# EasyEDA Pro project MAX2831_Standalone.eprj (continued)
## Nets (continued)
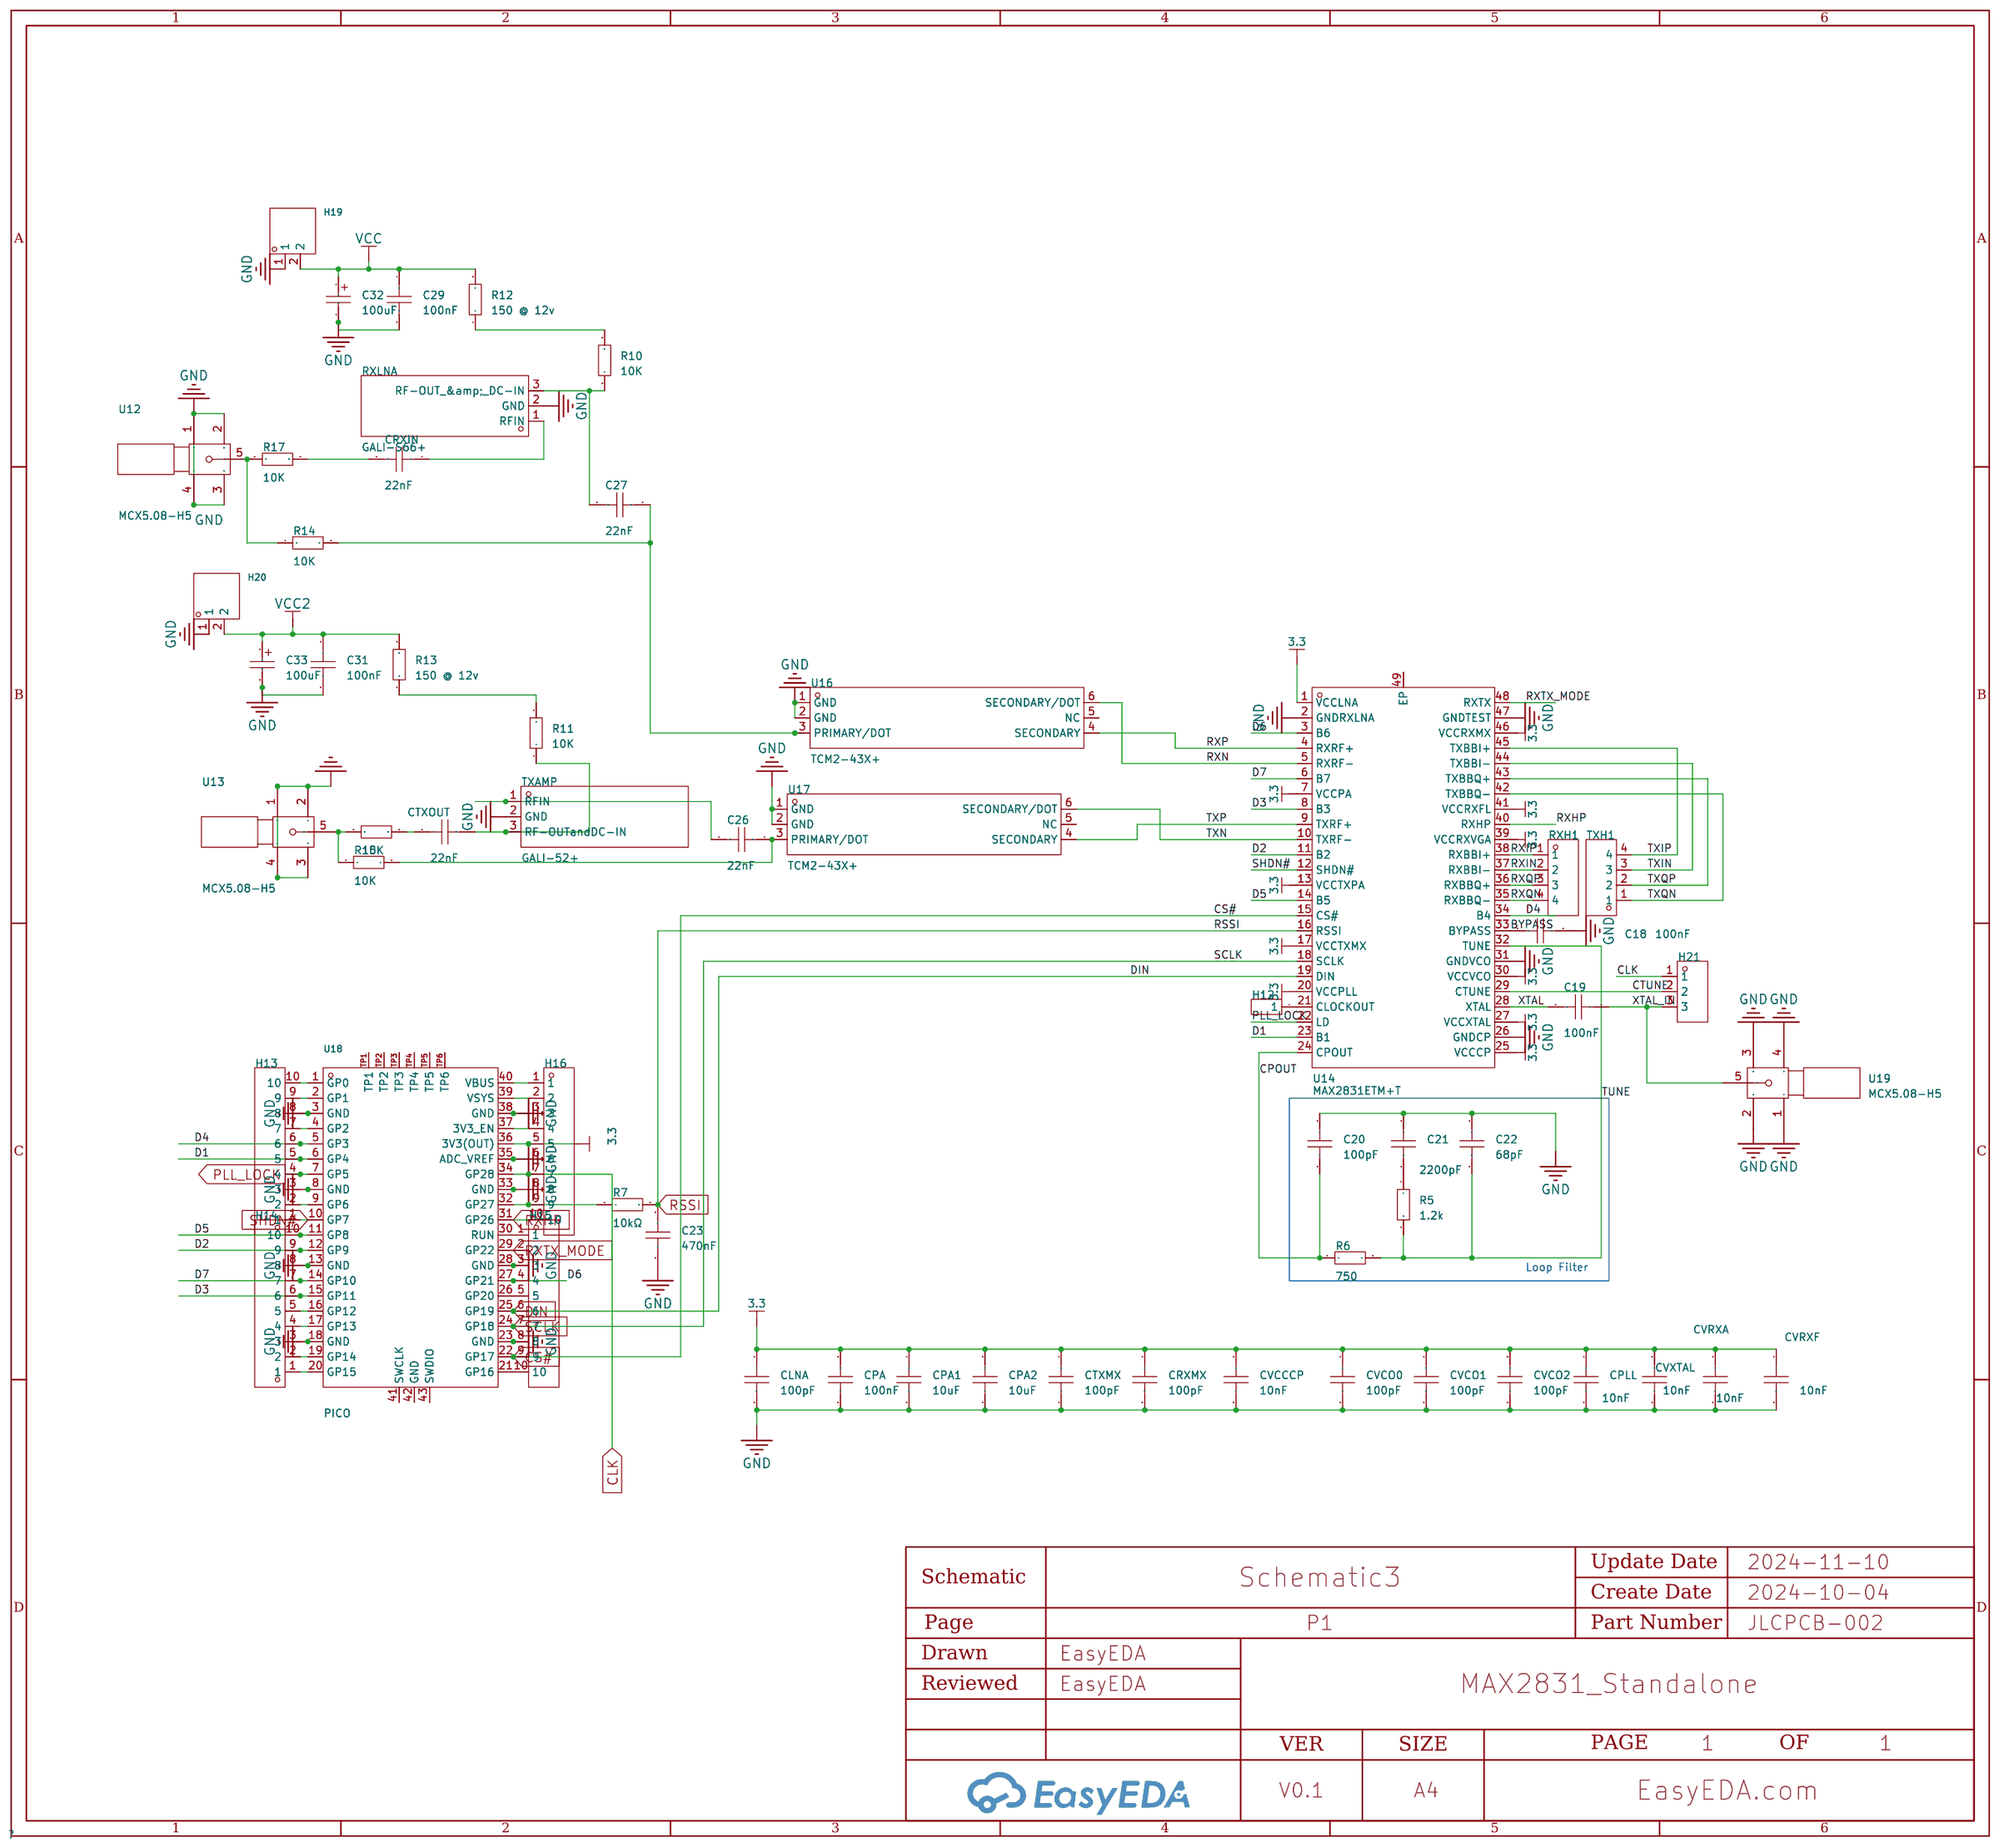
[diagram p2: schematic sheet]

## Parts
C18  100nF  [C0603]
C19  100nF  [C0603]
C20  100pF  [C0603]
C21  2200pF  [C0603]
C22  68pF  [C0603]
C23  470nF  [CAP-TH_L7.2-W2.5-P5.00-D0.5]
C26  22nF  [C0805]
C27  22nF  [C0805]
C29  100nF  [C0805]
C31  100nF  [C0805]
C32  100uF  [CAP-SMD_BD3.0-L3.3-W3.3-RD]
C33  100uF  [CAP-SMD_BD3.0-L3.3-W3.3-RD]
CLNA  100pF  [C0603]
CPA  100nF  [C0603]
CPA1  10uF  [C0603]
CPA2  10uF  [C0603]
CPLL  10nF  [C0603]
CRXIN  22nF  [C0805]
CRXMX  100pF  [C0603]
CTXMX  100pF  [C0603]
CTXOUT  22nF  [C0805]
CVCCCP  10nF  [C0603]
CVCO0  100pF  [C0603]
CVCO1  100pF  [C0603]
CVCO2  100pF  [C0603]
CVRXA  10nF  [C0603]
CVRXF  10nF  [C0603]
CVXTAL  10nF  [C0603]
H12  -  [HDR-TH_1P-V-M_XKB_X4611WV-01I-C28D40]
H13  -  [HDR-TH_10P-P2.54-V-F]
H14  -  [HDR-TH_10P-P2.54-V-F]
H15  -  [HDR-TH_10P-P2.54-V-F]
H16  -  [HDR-TH_10P-P2.54-V-F]
H19  -  [HDR-TH_2P-P2.54-V-M-1]
H20  -  [HDR-TH_2P-P2.54-V-M-1]
H21  -  [HDR-TH_3P-P2.54-V-M]
R5  1.2k  [R0603]
R6  750  [R0603]
R7  10kΩ  [RES-TH_BD1.8-L3.2-P7.20-D0.4]
R10  10K  [R0603]
R11  10K  [R0603]
R12  150 @ 12v  [R0603]
R13  150 @ 12v  [R0603]
R14  10K  [R0201]
R15  10K  [R0201]
R16  10K  [R0201]
R17  10K  [R0201]
RXH1  -  [HDR-TH_4P-P2.54-V-M]
RXLNA  GALI-S66+  [SOT-89-3_L4.5-W2.5-P1.50-LS4.2-BR]
TXAMP  GALI-52+  [SOT-89-3_L4.5-W2.5-P1.50-LS4.2-BR]
TXH1  -  [HDR-TH_4P-P2.54-V-M]
U12  MCX5.08-H5  [SMA-TH_MCX5.08-H5]
U13  MCX5.08-H5  [SMA-TH_MCX5.08-H5]
U14  MAX2831ETM+T  [TQFN-48_L7.0-W7.0-P0.50-TL-EP5.6]
U16  TCM2-43X+  [IND-SMD_6P-L4.1-W3.8-P1.27-TL]
U17  TCM2-43X+  [IND-SMD_6P-L4.1-W3.8-P1.27-TL]
U18  PICO  [COMM-SMD_L51.0-W21.0-P2.54_SC0916]
U19  MCX5.08-H5  [SMA-TH_MCX5.08-H5]

## Library data of the parts
C18-C22 CLNA CPA CPA1 CPA2 CPLL CRXMX CTXMX CVCCCP CVCO0-CVCO2 CVRXA CVRXF CVXTAL = CAP_0603: Supplier Footprint: 0603
C23 = C241J474J20C000: Capacitance:470nF Tolerance:±5% Tolerance:±5% Voltage Rated: Dielectric Material:Metallized Polyester Film Capacitor Operating Temperature:-55℃~+125℃ Operating Temperature:-55℃~+125℃; LCSC Part Name: 470nF ±5% 63V; Supplier Part: C5121927; Manufacturer: faratronic(厦门法拉); Supplier Footprint: 插件,P=5mm; JLCPCB Part Class: Extended Part; Datasheet: https://atta.szlcsc.com/upload/public/pdf/source/20220309/53E9D6585E584592026F1B9FCED89B93.pdf; Supplier: LCSC; Tolerance: ±5%; Dielectric Material: Metallized Polyester Film Capacitor; Operating Temperature: -55℃~+125℃
C26 C27 C29 C31 CRXIN CTXOUT = CAP_0805: Supplier Footprint: 0805
C32 C33 = C_Ele_SMD_3x5.4mm: Supplier Footprint: SMD,3x5.4mm
H12 = HDR-M_2.54_1x1P: Supplier Footprint: Through
H13-H16 = HDR-F_2.54_1x10P: Supplier Footprint: Through
H19 H20 = HDR-M_2.54_1x2P: Supplier Footprint: Through
H21 = HDR-M_2.54_1x3P: Supplier Footprint: Through
R5 R6 R10-R13 = Res_0603: Supplier Footprint: 0603
R7 = Res_AXIAL-1/8W: Supplier Footprint: Through
R14-R17 = Res_0201: Supplier Footprint: 0201
RXH1 TXH1 = HDR-M_2.54_1x4P: Supplier Footprint: Through
RXLNA = GALI-S66+: Applications:Mobile Phone；PCS Frequency Range:0Hz~3GHz Frequency Range:0Hz~3GHz Gain:16.4dB Noise Figure:2.4dB Supply Voltage:3V~4V Supply Voltage:3V~4V Supply Current:16mA; Supplier Part: C3193274; Manufacturer: Mini-Circuits; Supplier Footprint: SOT-89; JLCPCB Part Class: Extended Part; Supplier: LCSC; Applications: Mobile Phone；PCS; Frequency Range: 0Hz~3GHz; Gain: 16.4dB; Noise Figure: 2.4dB; Supply Voltage: 3V~4V; Supply Current: 16mA
TXAMP = GALI-52+: Applications:Cellular,PCS Frequency Range:0Hz~2GHz Frequency Range:0Hz~2GHz Gain:14.4dB Noise Figure:2.7dB Supply Voltage:4V~4.8V Supply Voltage:4V~4.8V Supply Current:50mA; Supplier Part: C2683445; Manufacturer: Mini-Circuits; Supplier Footprint: SOT-89-3; JLCPCB Part Class: Extended Part; Datasheet: https://atta.szlcsc.com/upload/public/pdf/source/20210107/C2683445_4C019D776B336260B8EA539DE99FD577.pdf; Supplier: LCSC; Applications: Cellular,PCS; Frequency Range: 0Hz~2GHz; Gain: 14.4dB; Noise Figure: 2.7dB; Supply Voltage: 4V~4.8V; Supply Current: 50mA
U12 U13 U19 = MCX5.08-H5_C9900009324: Supplier Part: C9900009324; Supplier Footprint: COAX-F; JLCPCB Part Class: Extended Part; Supplier: LCSC
U14 = MAX2831ETM+T: Frequency Range:2.4GHz Frequency Range:2.4GHz Interface:SPI Operating Voltage:2.7V~3.6V Operating Voltage:2.7V~3.6V Applications:WiFi Output Power:21dBm Data Rate:54Mbps Current Of Transmitting:82mA Sensitivity:-76dBm Receive Current:62mA Operating Temper; Supplier Part: C2152047; Manufacturer: ADI(亚德诺)/MAXIM(美信); Supplier Footprint: TQFN-48-EP(7x7); JLCPCB Part Class: Extended Part; Datasheet: https://atta.szlcsc.com/upload/public/pdf/source/20210601/D5E13A4F591163B65DE03F91E5182685.pdf; Supplier: LCSC; Frequency Range: 2.4GHz; Interface: SPI; Operating Voltage: 2.7V~3.6V; Applications: WiFi; Output Power: 21dBm; Data Rate: 54Mbps; Current Of Transmitting: 82mA; Sensitivity: -76dBm; Receive Current: 62mA; Operating Temperature: -40℃~+85℃
U16 U17 = TCM2-43X+: Frequency Range:10MHz~4GHz Frequency Range:10MHz~4GHz Impedance Ratio-Unbalanced/Balanced:1:2 Insertion Loss (Max):3dB Phase Balance:7° Return Loss (Min):14.98dB; LCSC Part Name: 射频变压器; Supplier Part: C2885644; Manufacturer: Mini-Circuits; Supplier Footprint: SMD-6P; JLCPCB Part Class: Extended Part; Datasheet: https://atta.szlcsc.com/upload/public/pdf/source/20210825/C2885644_24D8D5254C12C7AF6CFE8387515C0B6D.pdf; Supplier: LCSC; Frequency Range: 10MHz~4GHz; Impedance Ratio-Unbalanced/Balanced: 1:2; Insertion Loss (Max): 3dB; Phase Balance: 7°; Return Loss (Min): 14.98dB
U18 = PICO: Supplier Part: C7203002; Manufacturer: Raspberry Pi(树莓派); JLCPCB Part Class: Extended Part; Datasheet: https://atta.szlcsc.com/upload/public/pdf/source/20230906/086376002DDC9866828648BC93E51F8B.pdf; Supplier: LCSC

## Nets
GND: C18.1 C20.1 C21.1 C22.1 C23.1 C29.2 C31.2 C32.2 C33.2 CLNA.2 CPA.2 CPA1.2 CPA2.2 CPLL.2 CRXMX.2 CTXMX.2 CVCCCP.2 CVCO0.2 CVCO1.2 CVCO2.2 CVRXA.2 CVRXF.2 CVXTAL.2 H13.3 H13.8 H14.3 H14.8 H15.3 H15.8 H16.3 H16.6 H16.8 H19.1 H20.1 RXLNA.2(GND) TXAMP.2(GND) U12.1 U12.2 U12.3 U12.4 U13.1 U13.2 U13.3 U13.4 U14.2(GNDRXLNA) U14.26(GNDCP) U14.31(GNDVCO) U14.47(GNDTEST) U16.1(GND) U16.2(GND) U17.1(GND) U17.2(GND) U18.3(GND) U18.8(GND) U18.13(GND) U18.18(GND) U18.23(GND) U18.28(GND) U18.33(GND) U18.35(ADC_VREF) U18.38(GND) U19.1 U19.2 U19.3 U19.4
VCC: C29.1 C32.1 H19.2 R12.2
VCC2: C31.1 C33.1 H20.2 R13.2
3.3: CLNA.1 CPA.1 CPA1.1 CPA2.1 CPLL.1 CRXMX.1 CTXMX.1 CVCCCP.1 CVCO0.1 CVCO1.1 CVCO2.1 CVRXA.1 CVRXF.1 CVXTAL.1 H16.5 U14.1(VCCLNA) U14.7(VCCPA) U14.13(VCCTXPA) U14.17(VCCTXMX) U14.20(VCCPLL) U14.25(VCCCP) U14.27(VCCXTAL) U14.30(VCCVCO) U14.39(VCCRXVGA) U14.41(VCCRXFL) U14.46(VCCRXMX) U18.36(3V3(OUT))
BYPASS: C18.2 U14.33(BYPASS)
CLK: H16.7 H21.1 U18.34(GP28)
CPOUT: C20.2 R6.1 U14.24(CPOUT)
CS#: H15.9 U14.15(CS#) U18.22(GP17)
CTUNE: H21.2 U14.29(CTUNE)
D1: H13.5 U14.23(B1) U18.6(GP4)
D2: H14.9 U14.11(B2) U18.12(GP9)
D3: H14.6 U14.8(B3) U18.15(GP11)
D4: H13.6 U14.34(B4) U18.5(GP3)
D5: H14.10 U14.14(B5) U18.11(GP8)
D6: H15.4 U14.3(B6) U18.27(GP21)
D7: H14.7 U14.6(B7) U18.14(GP10)
DIN: H15.6 U14.19(DIN) U18.25(GP19)
PLL_LOCK: H13.4 U14.22(LD) U18.7(GP5)
RSSI: C23.2 R7.2 U14.16(RSSI)
RXHP: H16.10 U14.40(RXHP) U18.31(GP26)
RXIN: RXH1.2 U14.37(RXBBI-)
RXIP: RXH1.1 U14.38(RXBBI+)
RXN: U14.5(RXRF-) U16.6(SECONDARY/DOT)
RXP: U14.4(RXRF+) U16.4(SECONDARY)
RXQN: RXH1.4 U14.35(RXBBQ-)
RXQP: RXH1.3 U14.36(RXBBQ+)
RXTX_MODE: H15.2 U14.48(RXTX) U18.29(GP22)
SCLK: H15.7 U14.18(SCLK) U18.24(GP18)
SHDN#: H13.1 U14.12(SHDN#) U18.10(GP7)
TUNE: C22.2 R5.2 R6.2 U14.32(TUNE)
TXIN: TXH1.3 U14.44(TXBBI-)
TXIP: TXH1.4 U14.45(TXBBI+)
TXN: U14.10(TXRF-) U17.6(SECONDARY/DOT)
TXP: U14.9(TXRF+) U17.4(SECONDARY)
TXQN: TXH1.1 U14.42(TXBBQ-)
TXQP: TXH1.2 U14.43(TXBBQ+)
XTAL: C19.2 U14.28(XTAL)
XTAL_IN: C19.1 H21.3 U19.5
$1N1511: H12.1 U14.21(CLOCKOUT)
$1N2412: H14.1 U18.20(GP15)
$1N2414: H14.2 U18.19(GP14)
$1N2418: H14.4 U18.17(GP13)
$1N2420: H14.5 U18.16(GP12)
$1N2434: H13.2 U18.9(GP6)
$1N2444: H13.7 U18.4(GP2)
$1N2448: H13.9 U18.2(GP1)
$1N3367: C21.2 R5.1
$1N4614: H15.1 U18.30(RUN)
$1N4622: H15.5 U18.26(GP20)
$1N4632: H15.10 U18.21(GP16)
$1N4636: H16.2 U18.39(VSYS)
$1N5241: H16.9 R7.1 U18.32(GP27)
$1N12697: C26.1 R15.2 U17.3(PRIMARY/DOT)
$1N12710: C26.2 TXAMP.1(RFIN)
$1N12721: CTXOUT.1 R11.1 TXAMP.3(RF-OUTandDC-IN)
$1N12761: C27.1 R14.2 U16.3(PRIMARY/DOT)
$1N12820: R10.2 R12.1
$1N12851: R11.2 R13.1
$1N13115: C27.2 R10.1 RXLNA.3(RF-OUT &amp; DC-IN)
$1N13128: CRXIN.1 RXLNA.1(RFIN)
$1N13355: R14.1 R17.1 U12.5
$1N13417: CRXIN.2 R17.2
$1N13419: CTXOUT.2 R16.2
$1N13420: R15.1 R16.1 U13.5
$1N14592: H13.10 U18.1(GP0)
$1N14693: H16.1 U18.40(VBUS)
$1N14747: H16.4 U18.37(3V3_EN)

Not connected (* = marked no-connect by the designer): U14 49(EP); U16 5(NC); U17 5(NC); U18 41(SWCLK) 42(GND) 43(SWDIO) TP1 TP2 TP3 TP4 TP5 TP6

## Notes on the sheet
- Loop Filter

# Board PCB1
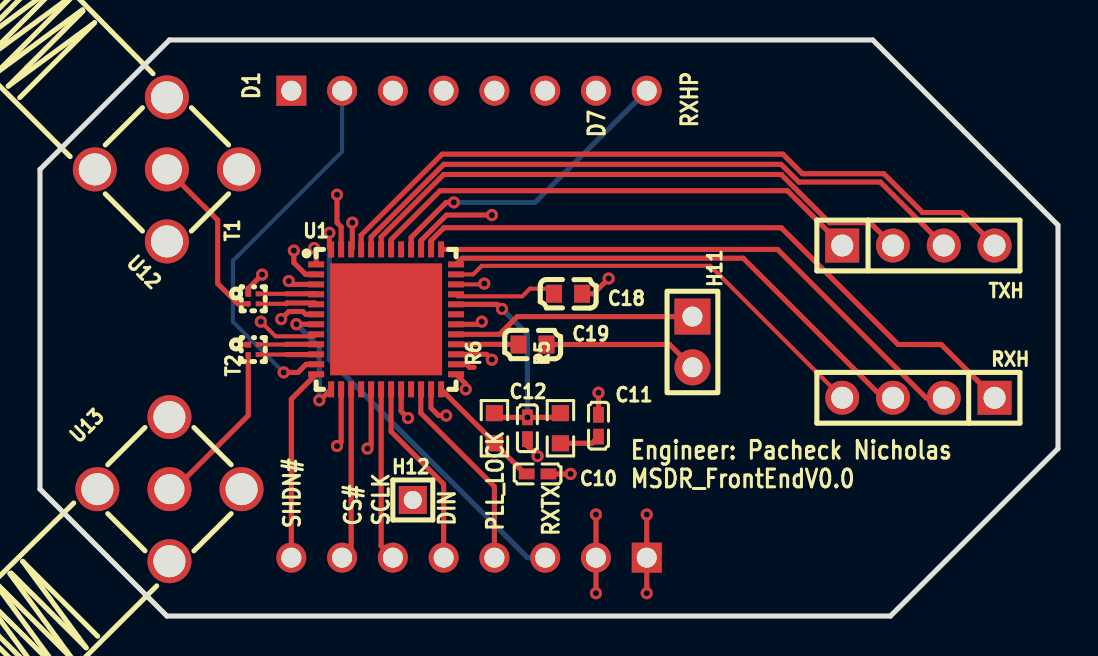
[diagram p3: board, top side]
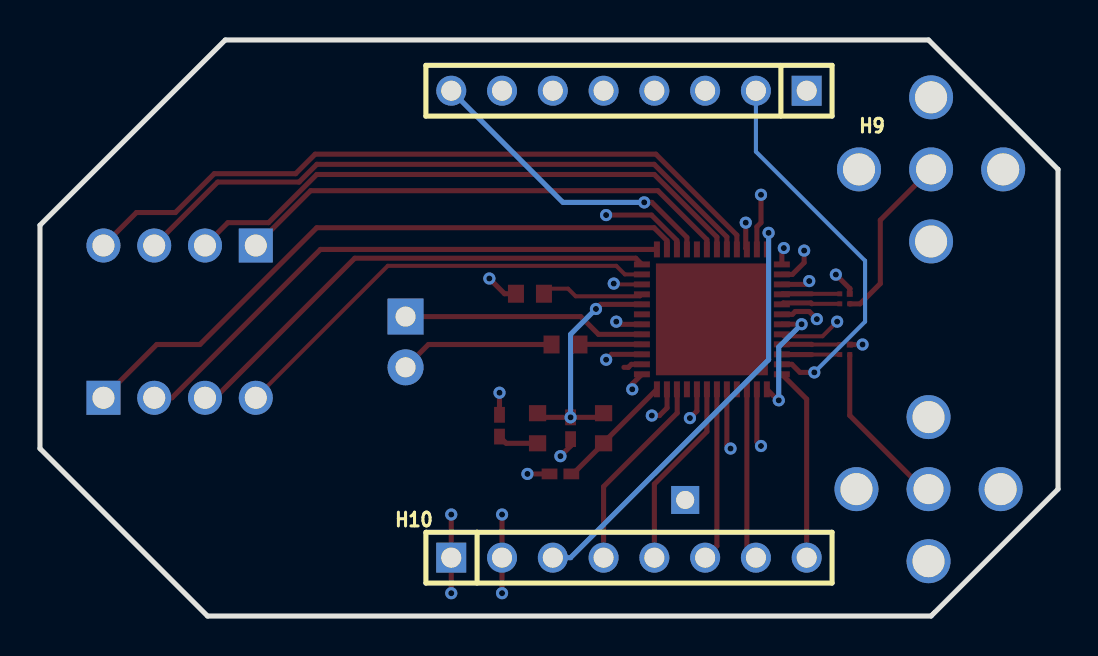
[diagram p4: board, bottom side, seen from below]

Outline 50.93 x 28.83 mm; copper layers: Top Layer, GND, Inner2, Inner3, 3.3, Bottom Layer. Coordinates in mm from the lower left corner of the outline.
Outline path: 0,22.35 0,6.35 6.35,0 42.55,0 50.93,8.38 50.93,19.56 41.66,28.83 6.48,28.83 0,22.35
Stack: Top Layer 0.035mm 外层铜厚1oz / Dielectric1 0.0994mm 3313 RC57% 4.2mil / GND 0.0152mm 内层铜厚 / Dielectric2 0.55mm 0.55mm H/H不含铜 / Inner2 0.0152mm 内层铜厚 / Dielectric3 0.1088mm 2116 RC54% 4.9mil / Inner3 0.0152mm 内层铜厚 / Dielectric4 0.55mm 0.55mm H/H不含铜 / 3.3 0.0152mm 内层铜厚 / Dielectric5 0.0994mm 3313 RC57% 4.2mil / Bottom Layer 0.035mm 外层铜厚1oz

## Design rules (mm)
template: JLCPCB Capability(Two Layers Board)
spacing copperThickness1oz (default): track to track 0.102, other pairs 0.152 to 0.3
spacing copperThickness2oz: track to track 0.203, other pairs 0.152 to 0.3
track width copperThickness1oz (default): min 0.127, default 0.254, max 2.54
track width copperThickness2oz: min 0.203, default 0.254, max 2.54
differential pair differentialPair (default): width min 0.127, default 0.254, max 2.54; gap min 0.152, default 0.152
via viaSize (default): diameter min 0.5, default 0.61, max 10; hole min 0.3, default 0.305, max 6.3

## Placement (name value [footprint] x y rotation side)
C10  100pF  [C0402]  24.89 7.11 180 top
C11  2200pF  [C0402]  27.94 9.53 270 top
C12  68pF  [C0402]  24.38 9.4 90 top
C18  100nF  [C0603]  26.42 16.13 180 top
C19  100nF  [C0603]  24.64 13.59 180 top
H9  -  [HDR-TH_8P-P2.54-V-M]  21.46 26.29 0 bottom
H10  -  [HDR-TH_8P-P2.54-V-M]  21.46 2.92 180 bottom
H11  -  [HDR-TH_2P-P2.54-V-M-1]  32.64 13.72 270 top
H12  -  [HDR-TH_1P-V-M_XKB_X4611WV-01I-C28D40]  18.65 5.81 0 top
R5  1.2k  [R0603]  26.04 9.4 90 top
R6  750  [R0603]  22.73 9.4 90 top
RXH  -  [HDR-TH_4P-P2.54-V-M]  43.94 10.92 180 top
T1  BD2327N50100AHF  [XFMR-SMD_4P-L1.1-W1.1-P0.50-BL]  10.67 15.88 270 top
T2  BD2327N50100AHF  [XFMR-SMD_4P-L1.1-W1.1-P0.50-BL]  10.67 13.34 270 top
TXH  -  [HDR-TH_4P-P2.54-V-M]  43.94 18.54 0 top
U1  MAX2831ETM+T  [tqfn-48_l7.0-w7.0-p0.50-tl-ep5.6]  17.32 14.85 0 top
U12  MCX5.08-H5  [SMA-TH_MCX5.08-H5]  6.35 22.35 135 top
U13  MCX5.08-H5  [SMA-TH_MCX5.08-H5]  6.48 6.35 225 top

## Footprints (pads in the part's own frame, mm; a bottom-side part is the same pattern mirrored in y, then rotated)
C0402
  rect 0.79x0.54 smd: 1(-0.545,0) 2(0.545,0)
C0603
  rect 0.8x0.9 smd: 1(-0.7,0) 2(0.7,0)
HDR-TH_1P-V-M_XKB_X4611WV-01I-C28D40
  rect 1.4x1.4 hole 0.9: 1(0,0)
HDR-TH_2P-P2.54-V-M-1
  rect 1.8x1.8 hole 1: 1(-1.27,0)
  round 1.8 hole 1: 2(1.27,0)
HDR-TH_4P-P2.54-V-M
  rect 1.7x1.7 hole 1.1: 1(-3.81,0)
  round 1.7 hole 1.1: 2(-1.27,0) 3(1.27,0) 4(3.81,0)
HDR-TH_8P-P2.54-V-M
  rect 1.5x1.5 hole 1: 1(-8.89,0)
  round 1.5 hole 1: 2(-6.35,0) 3(-3.81,0) 4(-1.27,0) 5(1.27,0) 6(3.81,0) 7(6.35,0) 8(8.89,0)
R0603
  rect 0.806x0.864 smd: 1(-0.753,0) 2(0.753,0)
SMA-TH_MCX5.08-H5
  round 2.2 hole 1.6: 1(-2.55,-2.55) 2(-2.55,2.55) 3(2.55,2.55) 4(2.55,-2.55)
  round 2.2 hole 1.5: 5(0,0)
tqfn-48_l7.0-w7.0-p0.50-tl-ep5.6
  rect 0.8x0.3 smd: 1(-3.5,2.751) 2(-3.5,2.251) 3(-3.5,1.75) 4(-3.5,1.251) 5(-3.5,0.75) 6(-3.5,0.252) 7(-3.5,-0.249) 8(-3.5,-0.75) 9(-3.5,-1.25) 10(-3.5,-1.75) 11(-3.5,-2.249) 12(-3.5,-2.748) 25(3.5,-2.748) 26(3.5,-2.249) 27(3.5,-1.75) 28(3.5,-1.25) 29(3.5,-0.75) 30(3.5,-0.249) 31(3.5,0.252) 32(3.5,0.75) 33(3.5,1.251) 34(3.5,1.75) 35(3.5,2.251) 36(3.5,2.751)
  rect 0.3x0.8 smd: 13(-2.751,-3.5) 14(-2.251,-3.5) 15(-1.75,-3.5) 16(-1.25,-3.5) 17(-0.75,-3.5) 18(-0.251,-3.5) 19(0.249,-3.5) 20(0.75,-3.5) 21(1.25,-3.5) 22(1.75,-3.5) 23(2.251,-3.5) 24(2.751,-3.5) 37(2.751,3.5) 38(2.251,3.5) 39(1.75,3.5) 40(1.25,3.5) 41(0.75,3.5) 42(0.251,3.5) 43(-0.251,3.5) 44(-0.75,3.5) 45(-1.25,3.5) 46(-1.75,3.5) 47(-2.251,3.5) 48(-2.751,3.5)
  rect 5.6x5.6 smd: 49(0,0.001)
XFMR-SMD_4P-L1.1-W1.1-P0.50-BL
  rect 0.3x0.3 smd: 1(-0.25,-0.25)
  rect 0.25x0.25 smd: 2(0.25,-0.25) 3(0.25,0.25) 4(-0.25,0.25)

## Nets
As in the schematic.

Pads without a net: U1 49

## Via types
v1: diameter 0.61, hole 0.305, Top Layer to Bottom Layer, 33 vias

## Routing (per net, layer and track width the routed paths; a pad name or vN(x,y) marks a point on that pad's centre or on a via; arc(x,y) is an arc through that point)
GND: length 16.5
  Top Layer w0.254: v1(12.7,18.29) 12.7,17.69 13.29,17.1 U1.2 ; 20.82,12.6 21.34,12.6 21.49,12.45 21.72,12.45 ; T1.1 10.42,16.38 10.41,16.38 10.41,16.39 v1(11.11,17.09) ; C18.1 27.69,16.13 v1(28.45,16.89) ; v1(30.35,1.14) H10.1 v1(30.35,5.08) ; U1.47 15.06,19.48 14.86,19.69 v1(14.86,21.08) ; C12.1 24.38,8.51 v1(24.89,8) ; v1(27.94,11.18) C11.1 ; T2.1 9.78,13.59 v1(9.78,13.59) ; v1(26.54,7.11) C10.1
3.3: length 25.6
  Top Layer w0.254: v1(27.81,5.08) H10.2 v1(27.81,1.14) ; U1.20 18.06,10.26 v1(18.42,9.91) ; v1(22.61,12.83) 22.34,13.1 U1.27 ; U1.7 13.81,14.61 v1(12.83,14.61) ; v1(13.72,18.42) 13.82,18.32 U1.1 ; v1(15.62,19.69) 15.62,18.4 U1.46 ; v1(21.3,11.35) 21.3,11.61 U1.25 ; v1(22.1,14.73) 21.96,14.6 U1.30 ; U1.13 14.01,10.8 v1(13.97,10.8) ; U1.17 16.57,8.56 v1(16.38,8.38) ; U1.39 19.07,18.79 20.34,20.07 v1(22.61,20.07)
  Bottom Layer w0.254: v1(13.97,10.8) 13.97,13.46 v1(12.83,14.61)
CPOUT: length 6.1
  Top Layer w0.254: 24.35,7.11 24.27,7.11 R6.1 22.73,8.68 U1.24
CS#: length 8.6
  Top Layer w0.254: H10.7 15.57,3.37 U1.15
CTUNE: length 12.2
  Top Layer w0.254: U1.29 22.99,14.1 23.88,14.99 H11.1
D1: length 33
  Top Layer w0.254: U1.23 19.56,11.34 19.56,10.41 19.94,10.03 v1(20.32,10.03)
  Inner3 w0.254: v1(20.32,10.03) 19.56,9.27 9.78,9.27 7.24,11.81 7.24,16.64 12.57,21.97 H9.1
D2: length 19.2
  Top Layer w0.254: v1(12.19,12.19) 12.91,12.19 13.31,12.6 13.82,12.6
  Bottom Layer w0.203: v1(12.19,12.19) 9.65,14.73 9.65,17.78 15.11,23.24 H9.2
D3: length 20
  Top Layer w0.203: U1.8 13.72,14 11.78,14 v1(11.05,14.73)
  Inner3 w0.203: v1(11.05,14.73) 11.81,13.97 13.59,13.97 17.65,18.03 H9.3
D4: length 13.1
  Top Layer w0.203: v1(22.23,16.64) 22.18,16.6 U1.34
  Inner3 w0.203: H9.4 23.62,22.86 23.62,18.03 v1(22.23,16.64)
D5: length 29.6
  Top Layer w0.254: U1.14 15.06,8.71 v1(14.86,8.51)
  Inner2 w0.254: H9.5 16.76,20.32 13.46,20.32 10.41,17.27 10.41,12.95 v1(14.86,8.51)
D6: length 18.3
  Top Layer w0.254: v1(12.45,16.76) 12.61,16.6 U1.3
  Inner2 w0.254: H9.6 15.62,16.64 12.57,16.64 v1(12.45,16.76)
D7: length 22.4
  Top Layer w0.254: U1.6 13.29,15.1 13.15,15.24 12.45,15.24 v1(12.07,14.86)
  Inner2 w0.254: H9.7 16.76,15.24 12.45,15.24 v1(12.07,14.86)
DIN: length 9.5
  Top Layer w0.254: U1.19 17.56,9.23 20.19,6.6 H10.5
PLL_LOCK: length 10
  Top Layer w0.254: U1.22 19.05,11.33 19.05,10.16 22.73,6.48 H10.4
RXHP: length 15.4
  Top Layer w0.254: U1.40 18.57,18.95 20.32,20.7 v1(20.7,20.7)
  Bottom Layer w0.254: H9.8 24.77,20.7 v1(20.7,20.7)
RXTX_MODE: length 22.1
  Top Layer w0.254: v1(14.48,19.18) 14.48,18.43 U1.48
  Bottom Layer w0.254: v1(14.48,19.18) 14.48,12.83 24.38,2.92 H10.3
SCLK: length 8.7
  Top Layer w0.254: H10.6 17.06,3.51 U1.18
SHDN#: length 9.7
  Top Layer w0.254: U1.12 12.57,10.86 H10.8
TUNE: length 11.8
  Top Layer w0.254: U1.32 22.88,15.6 v1(23.11,15.37) ; R6.2 22.94,9.94 v1(24.38,9.94) 25.83,9.94 R5.2
  Bottom Layer w0.254: v1(23.11,15.37) 24.38,14.1 v1(24.38,9.94)
XTAL: length 3.2
  Top Layer w0.254: U1.28 23.8,13.6 23.94,13.46
XTAL_IN: length 7.8
  Top Layer w0.254: C19.1 31.5,13.59 H11.2
$1N1573: length 2
  Top Layer w0.254: R5.1 27.6,8.64 C11.2
$1N2083: length 5.2
  Top Layer w0.203: C18.2 25.46,16.38 24.51,16.38 24.13,16 20.91,16 U1.33
$1N2220: length 2.9
  Top Layer w0.203: T1.4 12.32,16.12
  Top Layer w0.254: U1.4 13.79,16.12 12.32,16.12
$1N2222: length 2.9
  Top Layer w0.203: T1.3 12.32,15.62
  Top Layer w0.254: 12.32,15.62 12.36,15.67 13.74,15.67 U1.5
$1N2224: length 2.9
  Top Layer w0.203: T2.4 12.32,13.59
  Top Layer w0.254: 12.32,13.59 12.33,13.6 U1.9
$1N2226: length 2.9
  Top Layer w0.203: T2.3 12.32,13.09
  Top Layer w0.254: 12.32,13.09 13.8,13.09 U1.10
$1N4327: length 36
  Top Layer w0.254: TXH.4 46.1,20.19 44.15,20.19 42.21,22.14 38.14,22.14 37.16,23.11 20.12,23.11 16.07,19.06 U1.45
$1N4335: length 32.5
  Top Layer w0.254: TXH.3 42.04,21.72 37.96,21.72 37.08,22.61 20.2,22.61 16.57,18.97 U1.44
$1N4341: length 29
  Top Layer w0.254: U1.43 17.06,18.97 20.2,22.1 37.08,22.1 39.49,19.69 41.53,19.69 TXH.2
$1N4346: length 25.2
  Top Layer w0.254: U1.42 17.57,18.84 20.02,21.29 37.39,21.29 TXH.1
$1N4508: length 8.5
  Top Layer w0.254: U13.5 6.73,6.35 10.42,10.04 T2.2
$1N4512: length 8.7
  Top Layer w0.254: U12.5 8.89,19.81 8.89,16.64 9.91,15.62 10.41,15.62 T1.2
$1N6688: length 32.4
  Top Layer w0.254: RXH.1 45.08,13.59 42.93,13.59 37.08,19.43 20.21,19.43 19.56,18.78 19.56,18.35 U1.38
$1N6690: length 28.2
  Top Layer w0.254: RXH.2 44.32,10.92 36.9,18.35 U1.37
$1N6692: length 24.9
  Top Layer w0.254: RXH.3 42.16,10.92 35.18,17.91 21.12,17.91 U1.36
$1N6694: length 22.2
  Top Layer w0.203: RXH.4 33.53,17.53 22.1,17.53 21.67,17.1 U1.35

## Copper pours and planes (outline as drawn; the poured copper is in the pictures)
GND on GND: 1.65,22.48 2.87,22.48 2.87,21.26 1.65,21.26
GND on GND: 1.78,7.44 3,7.44 3,6.22 1.78,6.22
GND on GND: 5.26,27.05 6.48,27.05 6.48,25.83 5.26,25.83
GND on GND: 8.99,6.48 10.21,6.48 10.21,5.26 8.99,5.26
GND on GND: 0.26,28.57 50.67,28.57 50.67,0.26 0.26,0.26
GND on GND: 9.95,6.48 11.17,6.48 11.17,5.26 9.95,5.26
GND on GND: 2.74,7.44 3.96,7.44 3.96,6.22 2.74,6.22
GND on GND: 5.26,26.09 6.48,26.09 6.48,24.87 5.26,24.87